# EasyEDA Pro project 充电板.eprj

# Schematic 充电原理图
Create Date: 2024-07-01; Page Name: P1; Project Name: 充电板; Schematic Name: 充电原理图; Update Date: 2024-07-01; Company: 嘉立创EDA; Page Size: A4; Version: V1.0
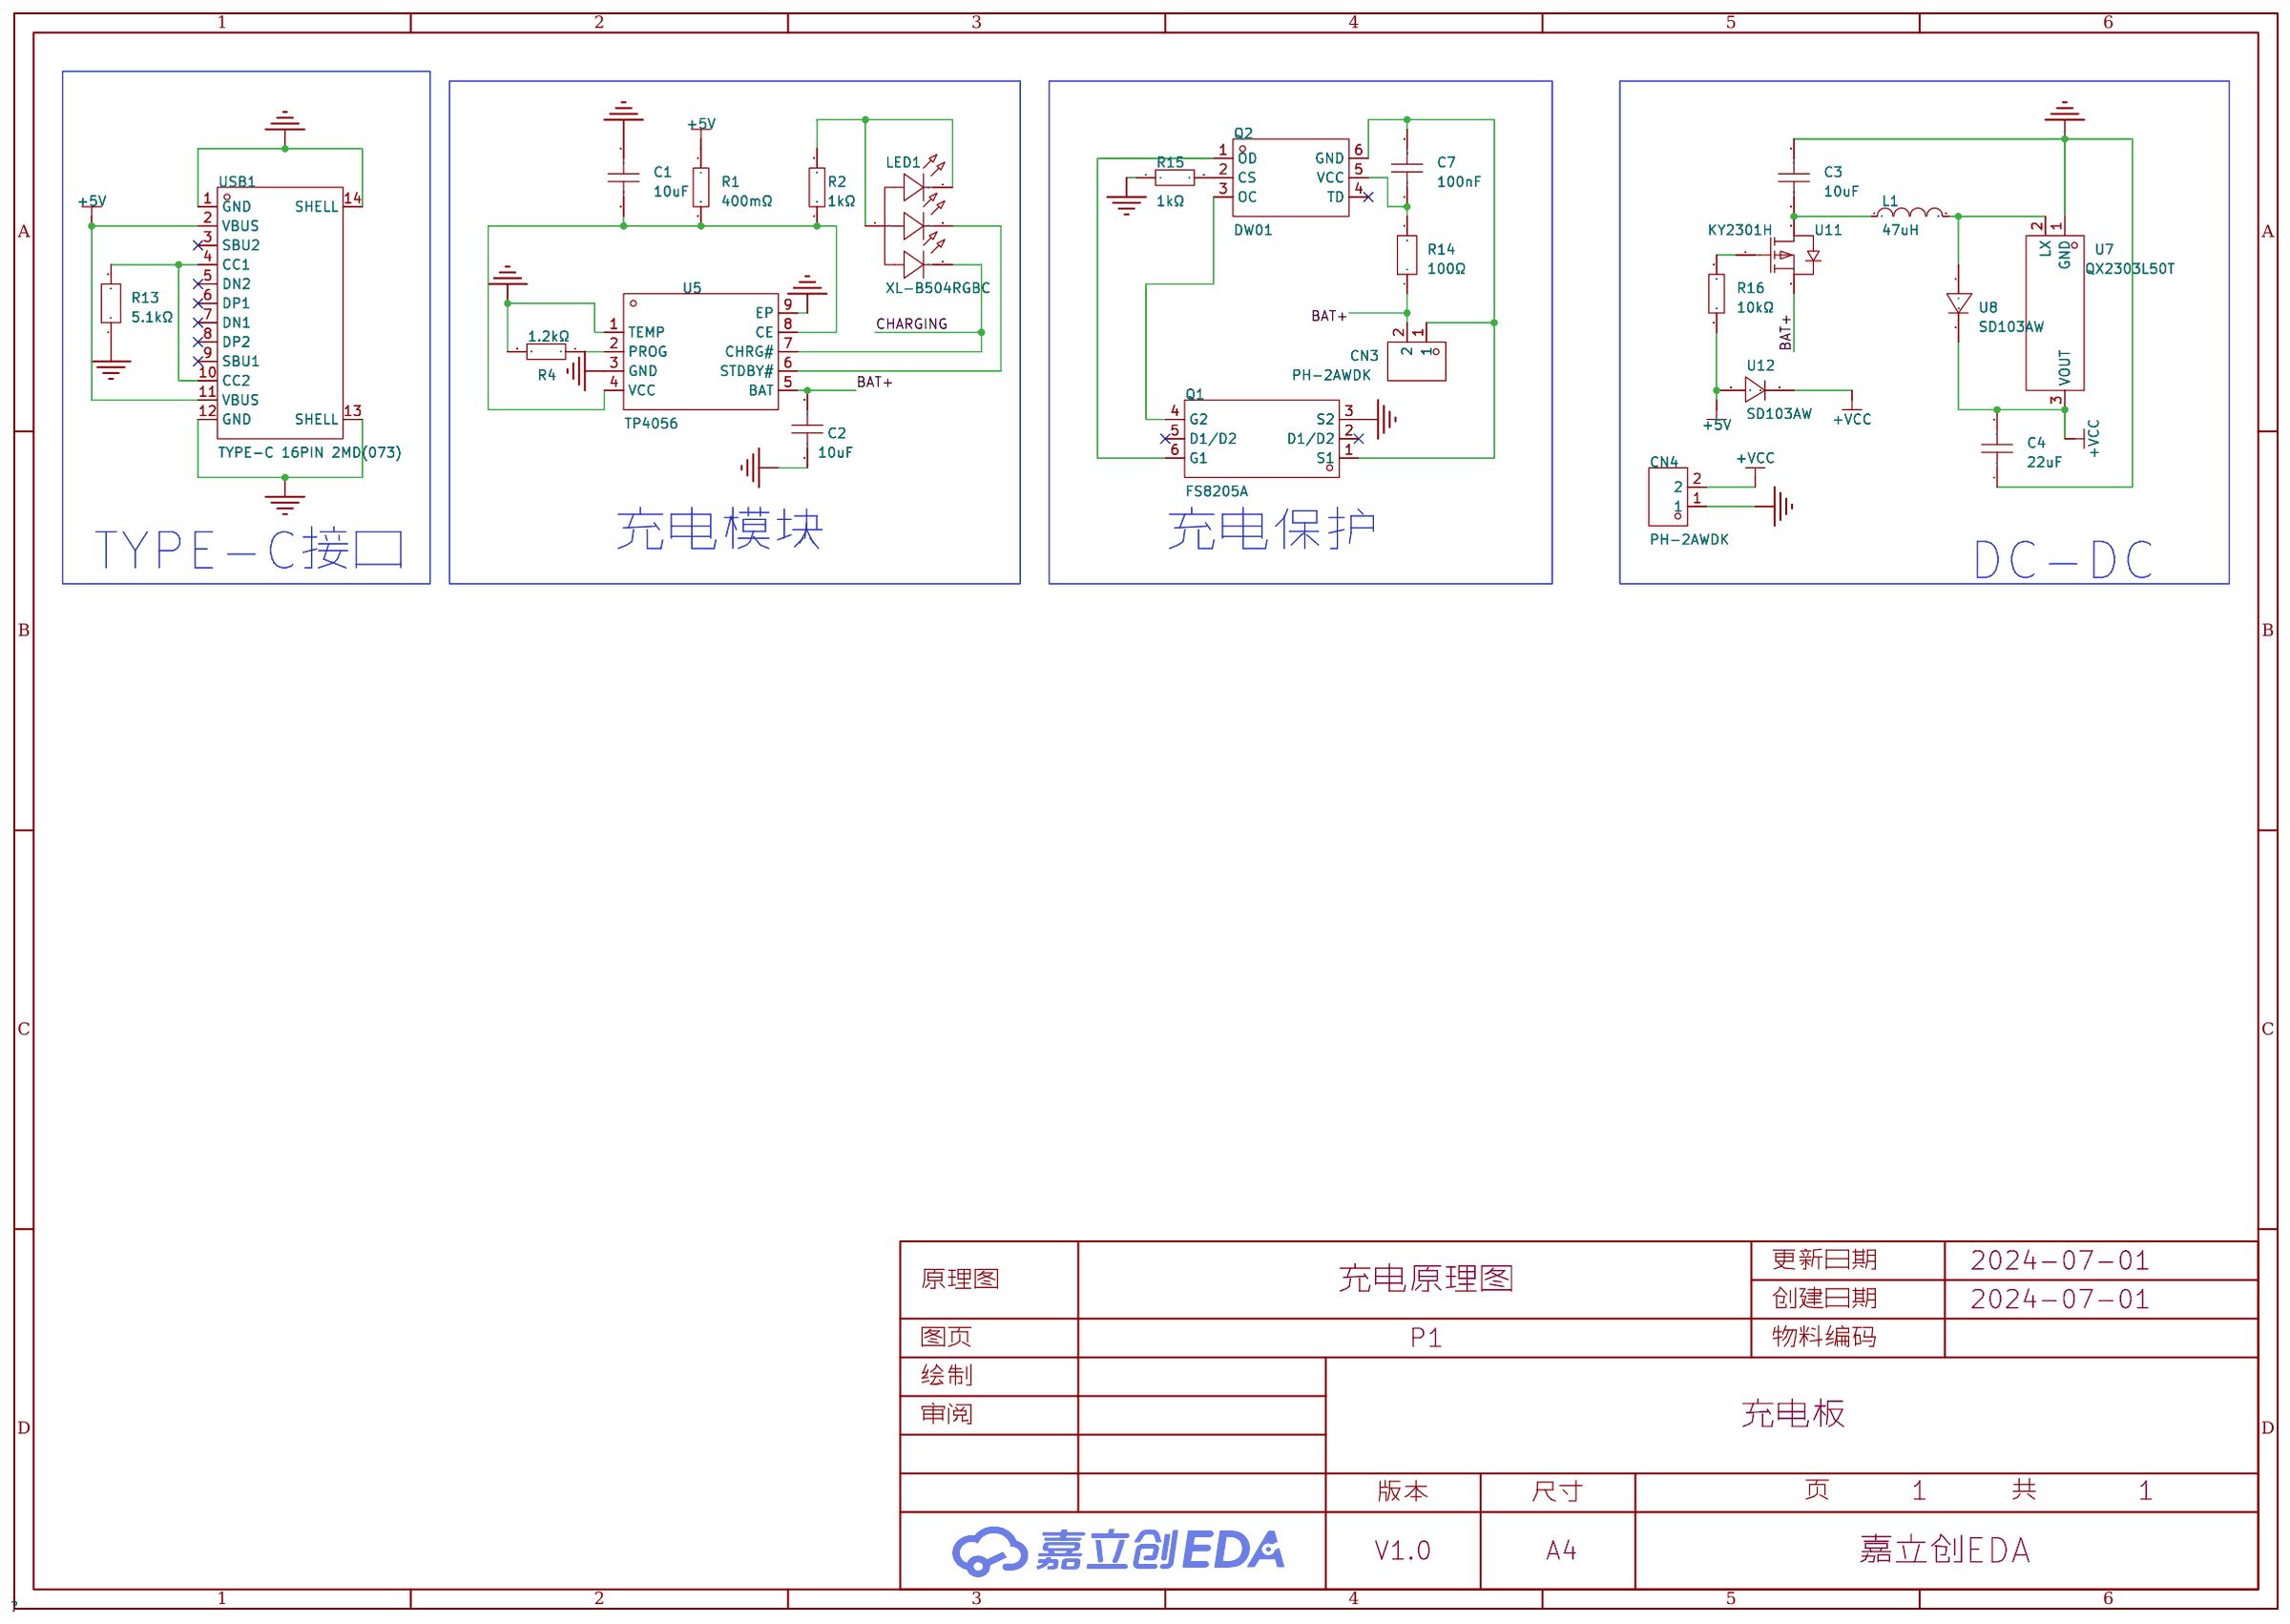
[diagram p0: schematic sheet]

## Parts
C1  10uF  [C0603]
C2  10uF  [C0603]
C3  10uF  [C0603]
C4  22uF  [C0603]
C7  100nF  [C0603]
CN3  PH-2AWDK  [CONN-TH_PH-2AWDK]
CN4  PH-2AWDK  [CONN-TH_PH-2AWDK]
L1  47uH  [IND-SMD_L4.5-W4.0_GCD43-XX]
LED1  XL-B504RGBC  [LED-TH_4P-BD5.8-P1.25]
Q1  FS8205A  [SOT-23-6_L2.9-W1.6-P0.95-LS2.8-BR]
Q2  DW01  [SOT-23-6_L2.9-W1.6-P0.95-LS2.8-BR]
R1  400mΩ  [R0603]
R2  1kΩ  [R0805]
R4  1.2kΩ  [R0603]
R13  5.1kΩ  [R0603]
R14  100Ω  [R0603]
R15  1kΩ  [R0805]
R16  10kΩ  [R0805]
U5  TP4056  [ESOP-8_L4.9-W3.9-P1.27-LS6.0-BL-EP]
U7  QX2303L50T  [SOT-23-3_L2.9-W1.6-P1.90-LS2.8-BR]
U8  SD103AW  [SOD-123_L2.8-W1.8-LS3.7-RD]
U11  KY2301H  [SOT-23-3_L2.9-W1.3-P1.90-LS2.4]
U12  SD103AW  [SOD-123_L2.8-W1.8-LS3.7-RD]
USB1  TYPE-C 16PIN 2MD(073)  [USB-C-SMD_TYPE-C-6PIN-2MD-073]

## Library data of the parts
C1-C3 = CL10A106MQ8NNNC: 容值:10uF;精度:±20%;额定电压:6.3V;材质(温度系数):X5R;; LCSC Part Name: 10uF ±20% 6.3V; Supplier Part: C1691; Manufacturer: SAMSUNG(三星); Supplier Footprint: 0603; JLCPCB Part Class: 扩展库; Datasheet: https://atta.szlcsc.com/upload/public/pdf/source/20160218/1457707763339.pdf; Supplier: LCSC; Tolerance: ±20%; Voltage Rated: 6.3V; Temperature Coefficient: X5R
C4 = CL10A226MQ8NRNC: 容值:22uF;精度:±20%;额定电压:6.3V;材质(温度系数):X5R;; LCSC Part Name: 22uF ±20% 6.3V; Supplier Part: C59461; Manufacturer: SAMSUNG(三星); Supplier Footprint: 0603; JLCPCB Part Class: 基础库; Datasheet: https://atta.szlcsc.com/upload/public/pdf/source/20160218/1457707763339.pdf; Supplier: LCSC; Tolerance: ±20%; Voltage Rated: 6.3V; Temperature Coefficient: X5R
C7 = CL10B104KB8NNNC: 容值:100nF;精度:±10%;额定电压:50V;材质(温度系数):X7R;; LCSC Part Name: 100nF ±10% 50V; Supplier Part: C1591; Manufacturer: SAMSUNG(三星); Supplier Footprint: 0603; JLCPCB Part Class: 扩展库; Datasheet: https://atta.szlcsc.com/upload/public/pdf/source/20160218/1457707763339.pdf; Supplier: LCSC; Tolerance: ±10%; Voltage Rated: 50V; Temperature Coefficient: X7R
CN3 CN4 = PH-2AWDK: 插针结构:1x2P;间距:2mm;安装方式:弯插;参考系列:-;总PIN数:2P;排数:1;每排PIN数:2;行距:-;额定电流:2A;工作温度范围:-25℃~+85℃;; LCSC Part Name: 1x2P 间距:2mm 弯插; Supplier Part: C722770; Manufacturer: CAX(创都); Supplier Footprint: 弯插,P=2mm; JLCPCB Part Class: 扩展库; Datasheet: https://atta.szlcsc.com/upload/public/pdf/source/20200902/C722770_2126FD87B413D40D3BC974724BF851A4.pdf; Supplier: LCSC; Pins Structure: 1x2P; Pitch: 2mm; Mounting Style: 弯插; Number of Pins: 2P; Number of Rows: 1; Number of PINs Per Row: 2; Current Rating (Max): 2A; Operating Temperature Range: -25℃~+85℃
L1 = CD42YP0402-470M: 电感值:47uH;精度:±20%;额定电流:400mA;; LCSC Part Name: 47uH ±20%; Supplier Part: C492272; Manufacturer: YJYCOIN(益嘉源); Supplier Footprint: SMD,4.5x4x2mm; JLCPCB Part Class: 扩展库; Datasheet: https://atta.szlcsc.com/upload/public/pdf/source/20200311/C492271_1AD102F2D00E7755211BAB8FE66CC08D.pdf; Supplier: LCSC; Tolerance: ±20%; Rated Current: 400mA; DC Resistance (DCR): 950mΩ
LED1 = XL-B504RGBC: F5七彩长脚透明共阳; Supplier Part: C7371895; Manufacturer: XINGLIGHT(成兴光); Supplier Footprint: 插件,D=5mm; JLCPCB Part Class: 扩展库; Datasheet: https://atta.szlcsc.com/upload/public/pdf/source/20240218/FDD5DF05EF14104572D4BED678224B3A.pdf; Supplier: LCSC
Q1 = FS8205A: 类型:2个N沟道;漏源电压(Vdss):20V;连续漏极电流(Id):6A;功率(Pd):1.5W;导通电阻(RDS(on)@Vgs,Id):19.5mΩ@4.5V,3A;阈值电压(Vgs(th)@Id):700mV@250uA;; LCSC Part Name: 2个N沟道 耐压:20V 电流:6A; Supplier Part: C2830320; Manufacturer: TECH PUBLIC(台舟); Supplier Footprint: SOT-23-6; JLCPCB Part Class: 扩展库; Datasheet: https://atta.szlcsc.com/upload/public/pdf/source/20210810/F53B6D4E8755A1F8E11BAF814CE98E6A.pdf; Supplier: LCSC; Type: 2个N沟道; Drain Source Voltage (Vdss): 20V; Continuous Drain Current (Id): 6A; Power Dissipation (Pd): 1.5W; Drain Source On Resistance (RDS(on)@Vgs,Id): 19.5mΩ@4.5V,3A; Gate Threshold Voltage (Vgs(th)@Id): 700mV@250uA; Total Gate Charge (Qg@Vgs): 5.7nC@10V; Input Capacitance (Ciss@Vds): 466pF@10V; Reverse Transfer Capacitance (Crss@Vds): 58pF@10V; Operating Temperature: -55℃~+150℃@(Tj)
Q2 = DW01_C181096: Supplier Part: C181096; Manufacturer: Hottech(合科泰); Supplier Footprint: SOT-23-6; JLCPCB Part Class: 扩展库; Datasheet: https://atta.szlcsc.com/upload/public/pdf/source/20231007/94AC323C2B651AEA18C7FC8F0156E5A9.pdf; Supplier: LCSC
R1 = 0603WAJ040KT5E: 电阻类型:厚膜电阻;阻值:400mΩ;精度:±5%;功率:100mW;最大工作电压:75V;; LCSC Part Name: 400mΩ ±5% 100mW 厚膜电阻; Supplier Part: C247571; Manufacturer: UNI-ROYAL(厚声); Supplier Footprint: 0603; JLCPCB Part Class: 扩展库; Supplier: LCSC; Type: 厚膜电阻; Tolerance: ±5%; Power(Watts): 100mW; Overload Voltage (Max): 75V; Operating Temperature Range: -55℃~+155℃
R2 R15 = RC0805FR-071KL: 电阻类型:厚膜电阻;阻值:1kΩ;精度:±1%;功率:125mW;最大工作电压:150V;温度系数:±100ppm/℃;; LCSC Part Name: 厚膜电阻 1kΩ ±1% 125mW; Supplier Part: C95781; Manufacturer: YAGEO(国巨); Supplier Footprint: 0805; JLCPCB Part Class: 扩展库; Datasheet: https://atta.szlcsc.com/upload/public/pdf/source/20170708/1499509500945.pdf; Supplier: LCSC; Type: 厚膜电阻; Tolerance: ±1%; Power(Watts): 125mW; Overload Voltage (Max): 150V; Temperature Coefficient: ±100ppm/℃; Operating Temperature Range: -55℃~+155℃
R4 = WR06X122JTL: 电阻类型:厚膜电阻;阻值:1.2kΩ;精度:±5%;功率:100mW;最大工作电压:75V;温度系数:±100ppm/℃;; LCSC Part Name: 厚膜电阻 1.2kΩ ±5% 100mW; Supplier Part: C168366; Manufacturer: Walsin(华新科); Supplier Footprint: 0603; JLCPCB Part Class: 扩展库; Datasheet: https://atta.szlcsc.com/upload/public/pdf/source/20191217/C470037_D99261402F77DA8B1D609223749D445A.pdf; Supplier: LCSC; Type: 厚膜电阻; Tolerance: ±5%; Power(Watts): 100mW; Overload Voltage (Max): 75V; Temperature Coefficient: ±100ppm/℃; Operating Temperature Range: -55℃~+155℃
R13 = SCR0603J5K1: 电阻类型:厚膜电阻;阻值:5.1kΩ;精度:±5%;功率:100mW;最大工作电压:75V;; LCSC Part Name: 厚膜电阻 5.1kΩ ±5% 100mW; Supplier Part: C3017721; Manufacturer: VO(翔胜); Supplier Footprint: 0603; JLCPCB Part Class: 扩展库; Datasheet: https://atta.szlcsc.com/upload/public/pdf/source/20220513/247AF9639BA21CF93567DC289CCC6A22.pdf; Supplier: LCSC; Type: 厚膜电阻; Tolerance: ±5%; Power(Watts): 100mW; Overload Voltage (Max): 75V; Operating Temperature Range: -55℃~+155℃
R14 = SCR0603J100R: 电阻类型:厚膜电阻;阻值:100Ω;精度:±5%;功率:100mW;最大工作电压:75V;; LCSC Part Name: 厚膜电阻 100Ω ±5% 100mW; Supplier Part: C3017758; Manufacturer: VO(翔胜); Supplier Footprint: 0603; JLCPCB Part Class: 扩展库; Datasheet: https://atta.szlcsc.com/upload/public/pdf/source/20220513/247AF9639BA21CF93567DC289CCC6A22.pdf; Supplier: LCSC; Type: 厚膜电阻; Tolerance: ±5%; Power(Watts): 100mW; Overload Voltage (Max): 75V; Operating Temperature Range: -55℃~+155℃
R16 = AC0805FR-0710KL: 电阻类型:厚膜电阻;阻值:10kΩ;精度:±1%;功率:125mW;最大工作电压:150V;温度系数:±100ppm/℃;; LCSC Part Name: 厚膜电阻 10kΩ ±1% 125mW; Supplier Part: C140868; Manufacturer: YAGEO(国巨); Supplier Footprint: 0805; JLCPCB Part Class: 扩展库; Datasheet: https://atta.szlcsc.com/upload/public/pdf/source/20180927/C229861_4ABDC471507C1ED6AFB4BA66AFC8620A.pdf; Supplier: LCSC; Type: 厚膜电阻; Tolerance: ±1%; Power(Watts): 125mW; Overload Voltage (Max): 150V; Temperature Coefficient: ±100ppm/℃; Operating Temperature Range: -55℃~+155℃
U5 = TP4056_C725790: Supplier Part: C725790; Manufacturer: UMW(友台半导体); Supplier Footprint: ESOP-8; JLCPCB Part Class: 扩展库; Datasheet: https://atta.szlcsc.com/upload/public/pdf/source/20231109/CF74897CE79A500F7FE27A45ADCCC631.pdf; Supplier: LCSC
U7 = QX2303L50T: 功能类型:升压型;输入电压:700mV~5V;输出电压:5V;输出电流(最大值):800mA;; Supplier Part: C219027; Manufacturer: 泉芯; Supplier Footprint: SOT-23; JLCPCB Part Class: 扩展库; Datasheet: https://atta.szlcsc.com/upload/public/pdf/source/20180504/C219029_F6F454D8D716C83066415AA2EC25C4AD.pdf; Supplier: LCSC; Function: 升压型; Input Voltage: 700mV~5V; Output Voltage: 5V; Output Current (Max): 800mA; Switching Frequency: 300kHz; Synchronous Rectification: 否; Number of Outputs: 1; Topology: 升压式; Switch tube (built-in/external): 内置
U8 U12 = SD103AW_C5345965: 二极管配置:独立式;正向压降(Vf):600mV@200mA;直流反向耐压(Vr):40V;平均整流电流(Io):350mA;; LCSC Part Name: 电压:40V 电流:350mA S4; Supplier Part: C5345965; Manufacturer: HXY MOSFET(华轩阳电子); Supplier Footprint: SOD-123; JLCPCB Part Class: 扩展库; Datasheet: https://atta.szlcsc.com/upload/public/pdf/source/20230718/C15AB3BEAEB1A66CBDFF5A426E492919.pdf; Supplier: LCSC; Diode Configuration: 独立式; Forward Voltage (Vf@If): 600mV@200mA; Reverse Voltage (Vr): 40V; Average Rectified Current (Io): 350mA; Reverse Leakage Current (Ir): 5uA@30V; Peak forward surge current: 2A
U11 = KY2301H: 类型:1个P沟道;漏源电压(Vdss):20V;连续漏极电流(Id):3A;功率(Pd):400mW;导通电阻(RDS(on)@Vgs,Id):76mΩ@4.5V,1A;阈值电压(Vgs(th)@Id):600mV@250uA;; LCSC Part Name: 1个P沟道 耐压:20V 电流:3A; Supplier Part: C3029274; Manufacturer: KY(韩景元); Supplier Footprint: SOT-23; JLCPCB Part Class: 扩展库; Datasheet: https://atta.szlcsc.com/upload/public/pdf/source/20220602/7F2945A9F5D68E0B5E25374511417CB5.pdf; Supplier: LCSC; Type: 1个P沟道; Drain Source Voltage (Vdss): 20V; Continuous Drain Current (Id): 3A; Power Dissipation (Pd): 400mW; Drain Source On Resistance (RDS(on)@Vgs,Id): 76mΩ@4.5V,1A; Gate Threshold Voltage (Vgs(th)@Id): 600mV@250uA; Total Gate Charge (Qg@Vgs): 6nC@2.5V; Input Capacitance (Ciss@Vds): 450pF@10V; Reverse Transfer Capacitance (Crss@Vds): 55pF@10V; Operating Temperature: -55℃~+150℃@(Tj)
USB1 = TYPE-C 16PIN 2MD(073): 连接器类型:Type-C;标准:-;公母:母;端口数量:1;触点数量:16P;安装方式:卧贴;额定电流 - 电源:5A;工作温度范围:-25℃~+85℃;; LCSC Part Name: Type-C 母 卧贴; Supplier Part: C2765186; Manufacturer: SHOU HAN(首韩); Supplier Footprint: SMD; JLCPCB Part Class: 扩展库; Datasheet: https://atta.szlcsc.com/upload/public/pdf/source/20211123/39B17C16241EAC15C5E277BDA434118E.pdf; Supplier: LCSC; Connector Type: Type-C; Gender: 母; Number of Ports: 1; Number of Contacts: 16P; Mounting Style: 卧贴; Current Rating - Power (Max): 5A; Operating Temperature Range: -25℃~+85℃

## Nets
+5V: R1.1 R16.1 U12.2(A) USB1.2(VBUS) USB1.11(VBUS)
+VCC: C4.2 CN4.2 U7.3(VOUT) U8.1(C) U12.1(C)
GND: C1.1 C2.1 C3.2 C4.1 CN4.1 Q1.3(S2) R4.2 R13.1 R15.1 U5.1(TEMP) U5.3(GND) U5.9(EP) U7.1(GND) USB1.1(GND) USB1.12(GND) USB1.13(SHELL) USB1.14(SHELL)
BAT+: C2.2 CN3.2 R14.1 U5.5(BAT) U11.2(S)
CHARGING: LED1.2(R-) U5.7(CHRG#)
$1N1137: LED1.3(G-) U5.6(STDBY#)
$1N1138: R4.1 U5.2(PROG)
$1N1143: LED1.1(A) LED1.4(B-) R2.2
$1N1144: C1.2 R1.2 R2.1 U5.4(VCC) U5.8(CE)
$1N1147: L1.2 U7.2(LX) U8.2(A)
$1N1150: R13.2 USB1.4(CC1) USB1.10(CC2)
$1N1152: Q1.4(G2) Q2.3(OC)
$1N1153: Q1.6(G1) Q2.1(OD)
$1N1154: Q2.2(CS) R15.2
$1N1159: R16.2 U11.1(G)
$1N1163: C3.1 L1.1 U11.3(D)
$1N1165: C7.2 CN3.1 Q1.1(S1) Q2.6(GND)
$1N1166: C7.1 Q2.5(VCC) R14.2

Not connected (* = marked no-connect by the designer): Q1 2(D1/D2)* 5(D1/D2)*; Q2 4(TD)*; USB1 3(SBU2)* 5(DN2)* 6(DP1)* 7(DN1)* 8(DP2)* 9(SBU1)*

## Notes on the sheet
- 充电模块
- 充电保护
- TYPE-C接口
- DC-DC

# Board PCB7
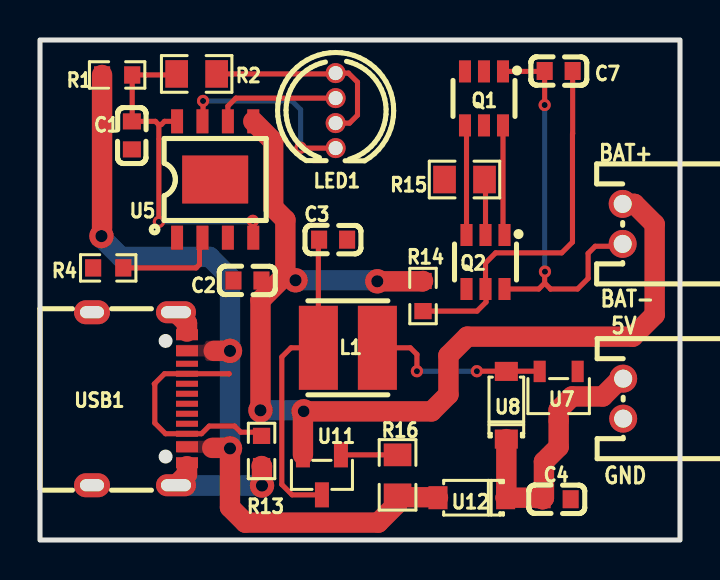
[diagram p1: board, top side]
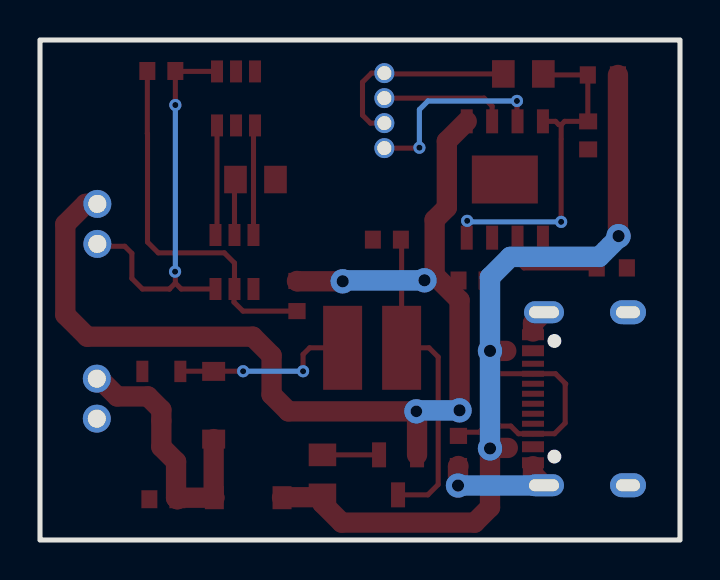
[diagram p2: board, bottom side, seen from below]

Outline 32 x 25 mm; copper layers: Top Layer, Bottom Layer. Coordinates in mm from the lower left corner of the outline.
Outline path: rectangle 0,25 32,0
Stack: Top Layer 0.035mm / Dielectric1 1.51mm FR4 er 4.5 / Bottom Layer 0.035mm

## Design rules (mm)
template: JLCPCB Capability(Two Layers Board)
spacing copperThickness1oz (default): track to track 0.102, other pairs 0.152 to 0.3
spacing copperThickness2oz: track to track 0.203, other pairs 0.152 to 0.3
track width copperThickness1oz (default): min 0.127, default 0.254, max 2.54
track width copperThickness2oz: min 0.203, default 0.254, max 2.54
differential pair differentialPair (default): width min 0.127, default 0.254, max 2.54; gap min 0.152, default 0.152
via viaSize (default): diameter min 0.5, default 0.61, max 10; hole min 0.3, default 0.305, max 6.3

## Placement (name value [footprint] x y rotation side)
C1  10uF  [C0603]  4.59 20.23 90 top
C2  10uF  [C0603]  10.37 12.98 0 top
C3  10uF  [C0603]  14.66 15.02 0 top
C4  22uF  [C0603]  25.83 2.04 180 top
C7  100nF  [C0603]  25.93 23.45 180 top
CN3  PH-2AWDK  [CONN-TH_PH-2AWDK]  29.13 15.81 90 top
CN4  PH-2AWDK  [CONN-TH_PH-2AWDK]  29.16 7.07 90 top
L1  47uH  [IND-SMD_L4.5-W4.0_GCD43-XX]  15.39 9.61 0 top
LED1  XL-B504RGBC  [LED-TH_4P-BD5.8-P1.25]  14.78 21.47 270 top
Q1  FS8205A  [SOT-23-6_L2.9-W1.6-P0.95-LS2.8-BR]  22.2 22.08 90 top
Q2  DW01  [SOT-23-6_L2.9-W1.6-P0.95-LS2.8-BR]  22.28 13.9 90 top
R1  400mΩ  [R0603]  3.86 23.25 0 top
R2  1kΩ  [R0805]  7.83 23.3 0 top
R4  1.2kΩ  [R0603]  3.41 13.61 180 top
R13  5.1kΩ  [R0603]  11.08 4.45 90 top
R14  100Ω  [R0603]  19.15 12.2 270 top
R15  1kΩ  [R0805]  21.23 18.02 0 top
R16  10kΩ  [R0805]  17.88 3.26 90 top
U5  TP4056  [ESOP-8_L4.9-W3.9-P1.27-LS6.0-BL-EP]  8.76 18.03 0 top
U7  QX2303L50T  [SOT-23-3_L2.9-W1.6-P1.90-LS2.8-BR]  25.93 7.19 90 top
U8  SD103AW  [SOD-123_L2.8-W1.8-LS3.7-RD]  23.32 6.74 90 top
U11  KY2301H  [SOT-23-3_L2.9-W1.3-P1.90-LS2.4]  14.1 3.26 90 top
U12  SD103AW  [SOD-123_L2.8-W1.8-LS3.7-RD]  21.59 2.11 180 top
USB1  TYPE-C 16PIN 2MD(073)  [USB-C-SMD_TYPE-C-6PIN-2MD-073]  4.98 7.06 270 top

## Footprints (pads in the part's own frame, mm; a bottom-side part is the same pattern mirrored in y, then rotated)
C0603
  rect 0.8x0.9 smd: 1(-0.7,0) 2(0.7,0)
CONN-TH_PH-2AWDK
  round 1.4 hole 0.9: 1(-1,0) 2(1,0)
ESOP-8_L4.9-W3.9-P1.27-LS6.0-BL-EP
  rect 0.6x1.2 smd: 1(-1.905,-2.909) 2(-0.635,-2.909) 3(0.635,-2.909) 4(1.905,-2.909) 5(1.905,2.909) 6(0.635,2.909) 7(-0.635,2.909) 8(-1.905,2.909)
  rect 3.3x2.4 smd: 9(0,0)
IND-SMD_L4.5-W4.0_GCD43-XX
  rect 1.95x4.2 smd: 1(-1.475,0) 2(1.475,0)
LED-TH_4P-BD5.8-P1.25
  round 1 hole 0.7: 1(0.625,0) 2(1.875,0) 3(-0.625,0) 4(-1.875,0)
R0603
  rect 0.806x0.864 smd: 1(-0.753,0) 2(0.753,0)
R0805
  rect 1.133x1.377 smd: 1(-1,0) 2(1,0)
SOD-123_L2.8-W1.8-LS3.7-RD
  rect 0.95x1.15 smd: 1(-1.692,0) 2(1.692,0)
SOT-23-3_L2.9-W1.3-P1.90-LS2.4
  rect 1.25x0.7 smd: 1(1,-0.95) 2(1,0.95) 3(-1,0)
SOT-23-3_L2.9-W1.6-P1.90-LS2.8-BR
  rect 1.07x0.6 smd: 1(1.235,-0.95) 2(1.235,0.95) 3(-1.235,0)
SOT-23-6_L2.9-W1.6-P0.95-LS2.8-BR
  rect 1.1x0.6 smd: 1(1.35,-0.95) 2(1.35,0) 3(1.35,0.95) 4(-1.35,0.95) 5(-1.35,0) 6(-1.35,-0.95)
USB-C-SMD_TYPE-C-6PIN-2MD-073
  rect 0.55x1.1 smd: 1(-3.2,2.375) 2(-2.4,2.375) 11(2.4,2.375) 12(3.2,2.375)
  rect 0.3x1.1 smd: 3(-1.75,2.375) 4(-1.25,2.375) 5(-0.75,2.375) 6(-0.25,2.375) 7(0.25,2.375) 8(0.75,2.375) 9(1.25,2.375) 10(1.75,2.375)
  oval 1.1x2 hole 0.6x1.5: 13(-4.325,1.825) 14(4.325,1.825)
  oval 1.2x1.8 hole 0.6x1.2: 13(-4.325,-2.375) 14(4.325,-2.375)

## Nets
As in the schematic.

Pads without a net: Q1 2 5; Q2 4; USB1 3 5 6 7 8 9

## Via types
v1: diameter 1.219, hole 0.61, Top Layer to Bottom Layer, 7 vias
v2: diameter 0.61, hole 0.305, Top Layer to Bottom Layer, 8 vias
v3: diameter 1.219, hole 0.584, Top Layer to Bottom Layer, 1 via

## Routing (per net, layer and track width the routed paths; a pad name or vN(x,y) marks a point on that pad's centre or on a via; arc(x,y) is an arc through that point)
+5V: length 39.5
  Top Layer w1.016: v1(9.5,9.45) 8.69,9.45 ; U12.2 19.87,2.14 18.16,2.14 ; 8.61,4.6 9.47,4.6 v1(9.5,4.58) 9.5,1.63 10.26,0.87 16.92,0.87 17.88,1.83 R16.1 ; R1.1 3.1,15.6
  Bottom Layer w1.016: v1(9.5,4.58) v1(9.5,9.45) 9.5,13.14 8.48,14.15 4.04,14.15 3.07,15.12 v1(3.07,15.2)
+VCC: length 13.6
  Top Layer w1.016: 29.16,8.19 28.14,7.18 26.6,7.18 25.93,6.51 U7.3 25.93,4.65 25.2,3.92 25.2,2.1 C4.2 25.06,2.11 U12.1 23.32,2.15 U8.1
GND: length 7.7
  Top Layer w1.016: 7.35,10.42 7.35,10.84 USB1.13 ; v1(11.1,2.72) 11.1,3.68 R13.1 ; 7.35,3.69 7.35,3.29 USB1.14
  Bottom Layer w1.016: v1(11.1,2.72) 6.81,2.72 USB1.14
BAT+: length 53.6
  Top Layer w1.016: 12.27,13.11 12.27,16.01 11.66,16.62 11.66,19.94 10.66,20.93 ; 12.12,13.09 11.02,11.99 v1(11.02,6.48) ; v1(16.87,12.94) 19.13,12.94 R14.1 ; CN3.2 29.72,16.81 30.73,15.79 30.73,11.26 29.64,10.17 21.36,10.17 20.42,9.23 20.42,7.27 19.58,6.43 v3(13.18,6.43) 13.15,6.4 U11.2
  Bottom Layer w1.016: v1(12.78,12.99) 16.81,12.99 v1(16.87,12.94) ; v1(11.02,6.48) 13.13,6.48 v3(13.18,6.43)
CHARGING: length 9.8
  Top Layer w0.254: 8.12,20.93 8.15,20.96 v2(8.15,21.95) ; LED1.2 13.05,19.59 v2(13.03,19.62)
  Bottom Layer w0.254: v2(8.15,21.95) 12.6,21.95 13.03,21.52 v2(13.03,19.62)
$1N1137: length 6.3
  Top Layer w0.254: 9.39,20.93 9.39,21.69 9.79,22.09 LED1.3
$1N1138: length 5.3
  Top Layer w0.254: U5.2 7.98,14.97 7.98,13.77 7.81,13.61 R4.1
$1N1143: length 10.2
  Top Layer w0.254: LED1.1 15.48,20.84 15.88,21.24 15.88,22.89 15.42,23.34 LED1.4 14.74,23.3 R2.2
$1N1144: length 17.3
  Top Layer w0.254: R2.1 6.78,23.25 R1.2 4.61,20.95 4.6,20.93 ; 4.6,20.93 C1.2 ; 4.6,20.93 5.77,20.93 5.93,20.77 5.94,20.77 ; 5.94,20.77 6.06,20.77 6.23,20.93 6.85,20.93 ; 5.94,20.77 5.94,20.07 ; v2(10.64,15.96) 10.67,15.94 10.67,15.12 ; v2(5.94,15.91) 5.94,20.02
  Bottom Layer w0.254: v2(10.64,15.96) 10.59,15.91 v2(5.94,15.91)
$1N1147: length 9.1
  Top Layer w0.254: 16.87,9.61 18.51,9.61 18.85,9.28 v2(18.85,8.44) ; 24.98,8.43 24.97,8.44 23.31,8.44 ; 23.31,8.44 U8.2 ; 23.31,8.44 v2(21.84,8.44)
  Bottom Layer w0.254: v2(18.85,8.44) v2(21.84,8.44)
$1N1150: length 11.8
  Top Layer w0.254: 9.45,8.3 9.45,8.31 9.45,8.31 USB1.4 6.22,8.31 5.72,7.8 5.74,7.78 5.74,5.85 6.28,5.31 USB1.10 8.07,5.31 8.46,5.7 9.73,5.7 10.03,5.39 10.89,5.39 11.08,5.2
$1N1152: length 5.5
  Top Layer w0.254: 21.25,20.73 21.33,20.65 Q2.3
$1N1153: length 5.5
  Top Layer w0.254: 23.15,20.73 23.15,15.33 Q2.1
$1N1154: length 2.8
  Top Layer w0.254: Q2.2 22.28,17.97 R15.2
$1N1159: length 2.8
  Top Layer w0.254: U11.1 17.88,4.26
$1N1163: length 16.1
  Top Layer w0.254: U11.3 12.61,2.26 12.09,2.78 12.09,9.15 12.55,9.61 L1.1 13.92,14.91 14.03,15.02
$1N1165: length 20.4
  Top Layer w0.254: 25.23,12.84 24.94,12.55 Q2.6 ; 25.23,12.84 25.52,12.56 25.52,12.55 26.88,12.55 27.41,13.08 27.41,14.33 27.76,14.69 29.02,14.69 CN3.1 ; 25.23,12.84 25.23,13.4 v2(25.25,13.42) ; v2(25.23,21.75) 25.23,23.22 25.03,23.43 Q1.1
  Bottom Layer w0.254: v2(25.25,13.42) 25.23,13.43 v2(25.23,21.75)
$1N1166: length 18.4
  Top Layer w0.254: 26.63,23.22 26.63,20.32 26.62,20.31 26.62,14.9 26.09,14.36 22.78,14.36 22.28,13.85 Q2.5 22.3,12.53 22.3,11.89 21.85,11.45 R14.2

## Copper pours and planes (outline as drawn; the poured copper is in the pictures)
+5V on Top Layer: 6.8,5.11 9.28,5.11 9.28,4.1 6.8,4.1
+5V on Top Layer: 6.8,9.97 9.18,9.97 9.18,8.95 6.8,8.95
GND on Top Layer: -1.37,26.02 33.55,26.02 33.55,-1.14 -1.37,-1.14

## Text on the board
Top Silkscreen Layer: BAT+ | BAT- | GND | 5V | U7
